# EasyEDA Pro project Geacon3.eprj, board Geacon_1 (continued)
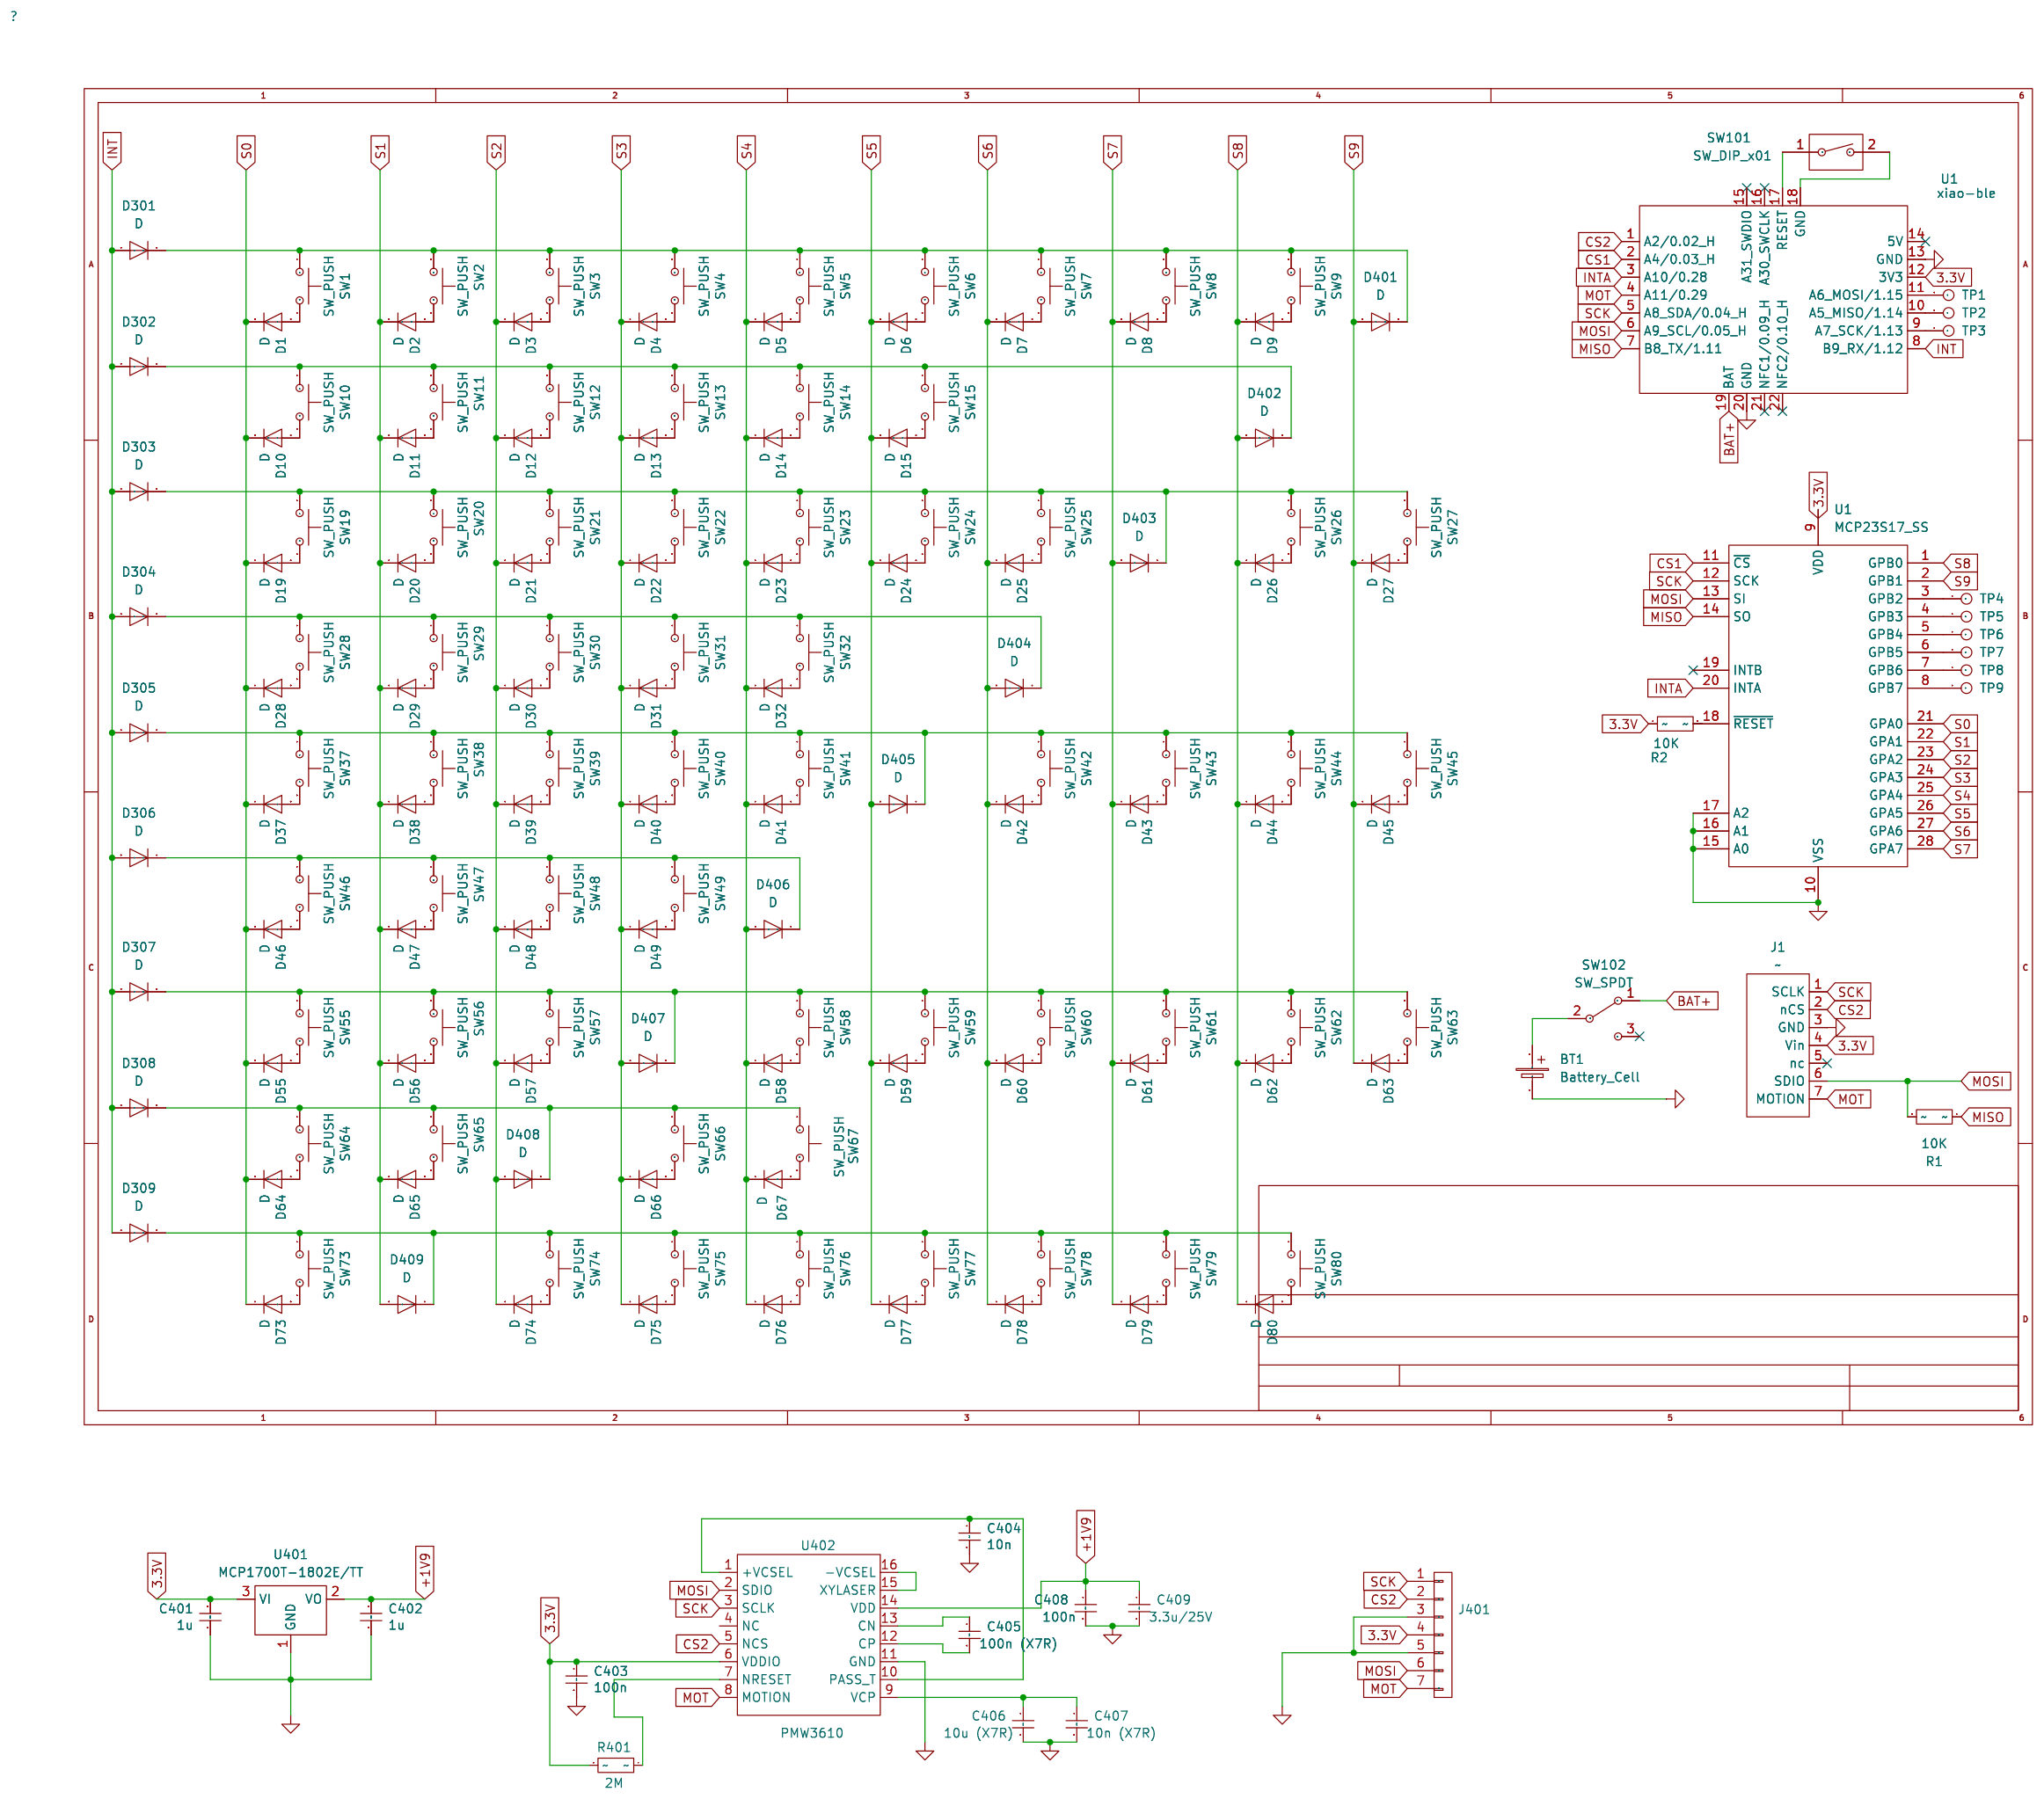
[diagram p0: schematic sheet]
## Routing (per net, layer and track width the routed paths; a pad name or vN(x,y) marks a point on that pad's centre or on a via; arc(x,y) is an arc through that point) (continued)
S6: length 310.5
  Top Layer w0.25: v1(68.86,117.45) 68.86,117.16 81.28,104.74 87.89,104.74 88.44,104.19 125.47,104.19 134.66,94.99 v1(134.66,86.74) 144.83,76.58 v1(144.83,67.53) 130.86,53.56 v1(130.86,48.64) 139.75,39.75 v1(139.75,28.93) 142.28,26.39 v1(142.28,25.78)
  Bottom Layer w0.25: v1(139.75,28.93) 139.11,28.29 137.25,28.29 ; v1(130.86,48.64) 129.6,47.39 127.75,47.39 ; 68.39,120.82 68.39,117.92 v1(68.86,117.45) ; 256.75,14.89 256.61,15.03 249.05,15.03 242.14,21.93 241.66,21.93 241.49,22.09 241.49,25.06 231.99,34.57 197.12,34.57 196.72,34.16 195.42,34.16 195.17,33.91 185.48,33.91 185.04,33.47 185.04,33.46 183.74,32.16 177.94,32.16 177.56,31.78 176.13,31.78 175.75,32.16 169.39,32.16 163.02,25.78 v1(142.28,25.78) ; 133.61,85.69 140.85,85.69 141.02,85.85 ; 133.61,85.69 v1(134.66,86.74) ; 133.61,85.69 132.34,85.69 ; 142.34,66.69 143.98,66.69 v1(144.83,67.53)
S7: length 312.8
  Top Layer w0.25: v1(147.74,83.35) 148.4,82.68 148.4,50.14 v1(149.91,48.64) 160.06,38.48 v1(160.06,29.59) 160.06,24.06 v1(160.21,23.92) ; v1(120.7,85.47) 119.43,86.74 v1(119.43,99.44) ; v1(69.9,118.49) 71.42,116.97 75.15,116.97 77.64,114.47 78.72,114.47 88.6,104.59 114.79,104.59 v1(115.62,105.41)
  Bottom Layer w0.25: 157.15,29.84 158.55,29.84 158.8,29.59 v1(160.06,29.59) ; v1(115.62,105.41) 115.62,103.25 v1(119.43,99.44) ; 150.19,84.58 152.25,86.64 ; 150.19,84.58 150.16,84.61 128.34,84.61 128.31,84.58 121.59,84.58 v1(120.7,85.47) ; 150.19,84.58 150.19,84.49 149.05,83.35 v1(147.74,83.35) ; v1(149.91,48.64) 148,48.64 147.65,48.29 ; v1(160.21,23.92) 160.59,24.3 162.11,24.3 169.56,31.76 175.58,31.76 175.96,31.38 177.73,31.38 178.11,31.76 183.91,31.76 185.44,33.29 185.44,33.3 185.65,33.51 195.34,33.51 195.59,33.76 196.88,33.76 197.29,34.17 231.67,34.17 241.09,24.74 241.09,21.93 241.49,21.53 241.98,21.53 248.88,14.62 255.38,14.62 256.03,13.98 257.46,13.98 257.98,14.5 274.67,14.5 275.26,15.09 275.64,15.09 ; v1(69.9,118.49) 69.9,119.97 69.04,120.82
S8: length 314.8
  Top Layer w0.25: v1(71.17,112.14) 80.06,103.25 v1(80.06,94.36) ; v1(163.24,84.84) 163.88,84.2 v1(163.88,68.96) 170.22,62.61 v1(170.22,51.18) 178.86,42.55 v1(178.86,33.31) 179.34,32.83 v1(186.12,32.83)
  Bottom Layer w0.25: v1(163.88,68.96) 162.42,68.96 161.94,68.49 ; 176.84,32.69 177.85,32.69 178.47,33.31 v1(178.86,33.31) ; v1(71.17,112.14) 69.69,113.62 69.04,113.62 ; 177.84,92.2 174.41,92.2 171.55,89.34 167.74,89.34 v1(163.24,84.84) 161.23,82.83 159.26,82.83 159,82.57 146.46,82.57 144.87,84.16 134.16,84.16 133.81,83.81 110.93,83.81 103.42,91.32 83.1,91.32 v1(80.06,94.36) ; v1(186.12,32.83) 189.31,32.83 189.59,33.11 195.5,33.11 197.05,33.36 197.46,33.76 231.5,33.76 236.74,28.53 236.74,23.22 238.15,21.81 238.15,21.63 238.78,21 238.96,21 245.73,14.22 246.05,14.22 246.3,13.97 252.8,13.97 253.32,13.45 255.09,13.45 255.45,13.81 255.63,13.81 255.86,13.58 257.63,13.58 258.02,13.97 278.62,13.97 280.02,15.37 280.78,15.37 280.91,15.24 283.44,15.24 ; v1(170.22,51.18) 168.96,51.18 168.16,50.39 167.05,50.39
S9: length 197.8
  Top Layer w0.25: v1(121.97,105.41) 121.97,107.06 v1(118.16,110.87) ; v1(198.16,37.21) 198.16,46.1 v1(189.28,54.99) 189.28,66.42 184.19,71.5 v1(184.19,72.77) 184.19,80.39 175.31,89.28 v1(160.06,89.28) 157.53,91.82 v1(157.53,101.98)
  Bottom Layer w0.25: 195.55,36.39 196.6,36.39 197.42,37.21 v1(198.16,37.21) ; v1(121.97,105.41) 126.3,101.08 156.62,101.08 v1(157.53,101.98) ; v1(184.19,72.77) 183.16,71.74 181.34,71.74 ; v1(189.28,54.99) 188.27,53.99 186.44,53.99 ; v1(118.16,110.87) 70.02,110.87 68.39,112.5 68.39,113.62 ; 158.8,89.66 159.69,89.66 v1(160.06,89.28)
SCK: length 372.6
  Top Layer w0.249: J1.1 234.96,21.91 241.51,28.47 v2(241.51,28.9) ; v2(198.16,109.97) 192.82,109.97 v2(192.74,110.05)
  Bottom Layer w0.249: v2(198.16,109.97) 198.46,109.67 286.99,109.67 289.77,106.88 289.77,40.07 280.12,30.42 244.94,30.42 243.41,28.9 v2(241.51,28.9) ; 128.45,111.27 136.9,102.82 161.25,102.82 168.48,110.05 v2(192.74,110.05)
  Bottom Layer w0.25: 61.89,113.62 61.89,110.21 63.36,108.75 65.2,108.75 66.89,107.06 124.58,107.06 128.62,111.1

## Copper pours and planes (outline as drawn; the poured copper is in the pictures)
GND on Top Layer: 306.69,125.88 -4.81,129.38 -5.05,-17.49 306.74,-16.22
GND on Bottom Layer: 306.31,129.06 -5.19,132.56 -5.43,-14.32 306.36,-13.05

## Text on the board
Bottom Solder Mask Layer: Geacon
Top Layer: Geacon
Top Silkscreen Layer: SCK / NCS / GND / 3.3V / X / MOSI / MOT | - | + | Geacon as a Beacon by ZMK, inspired by the Grin layout, / lying in wait at the root of the tree, said to bring forth the sun.     20250118 by te9no
